# EasyEDA Pro project 嵌入式.eprj, schematic Schematic1
Create Date: 2024-04-08; Page Name: 6612; Project Name: 嵌入式; Schematic Name: Schematic1; Update Date: 2024-04-08; Company: 嘉立创EDA; Page Size: A4; Version: V1.0
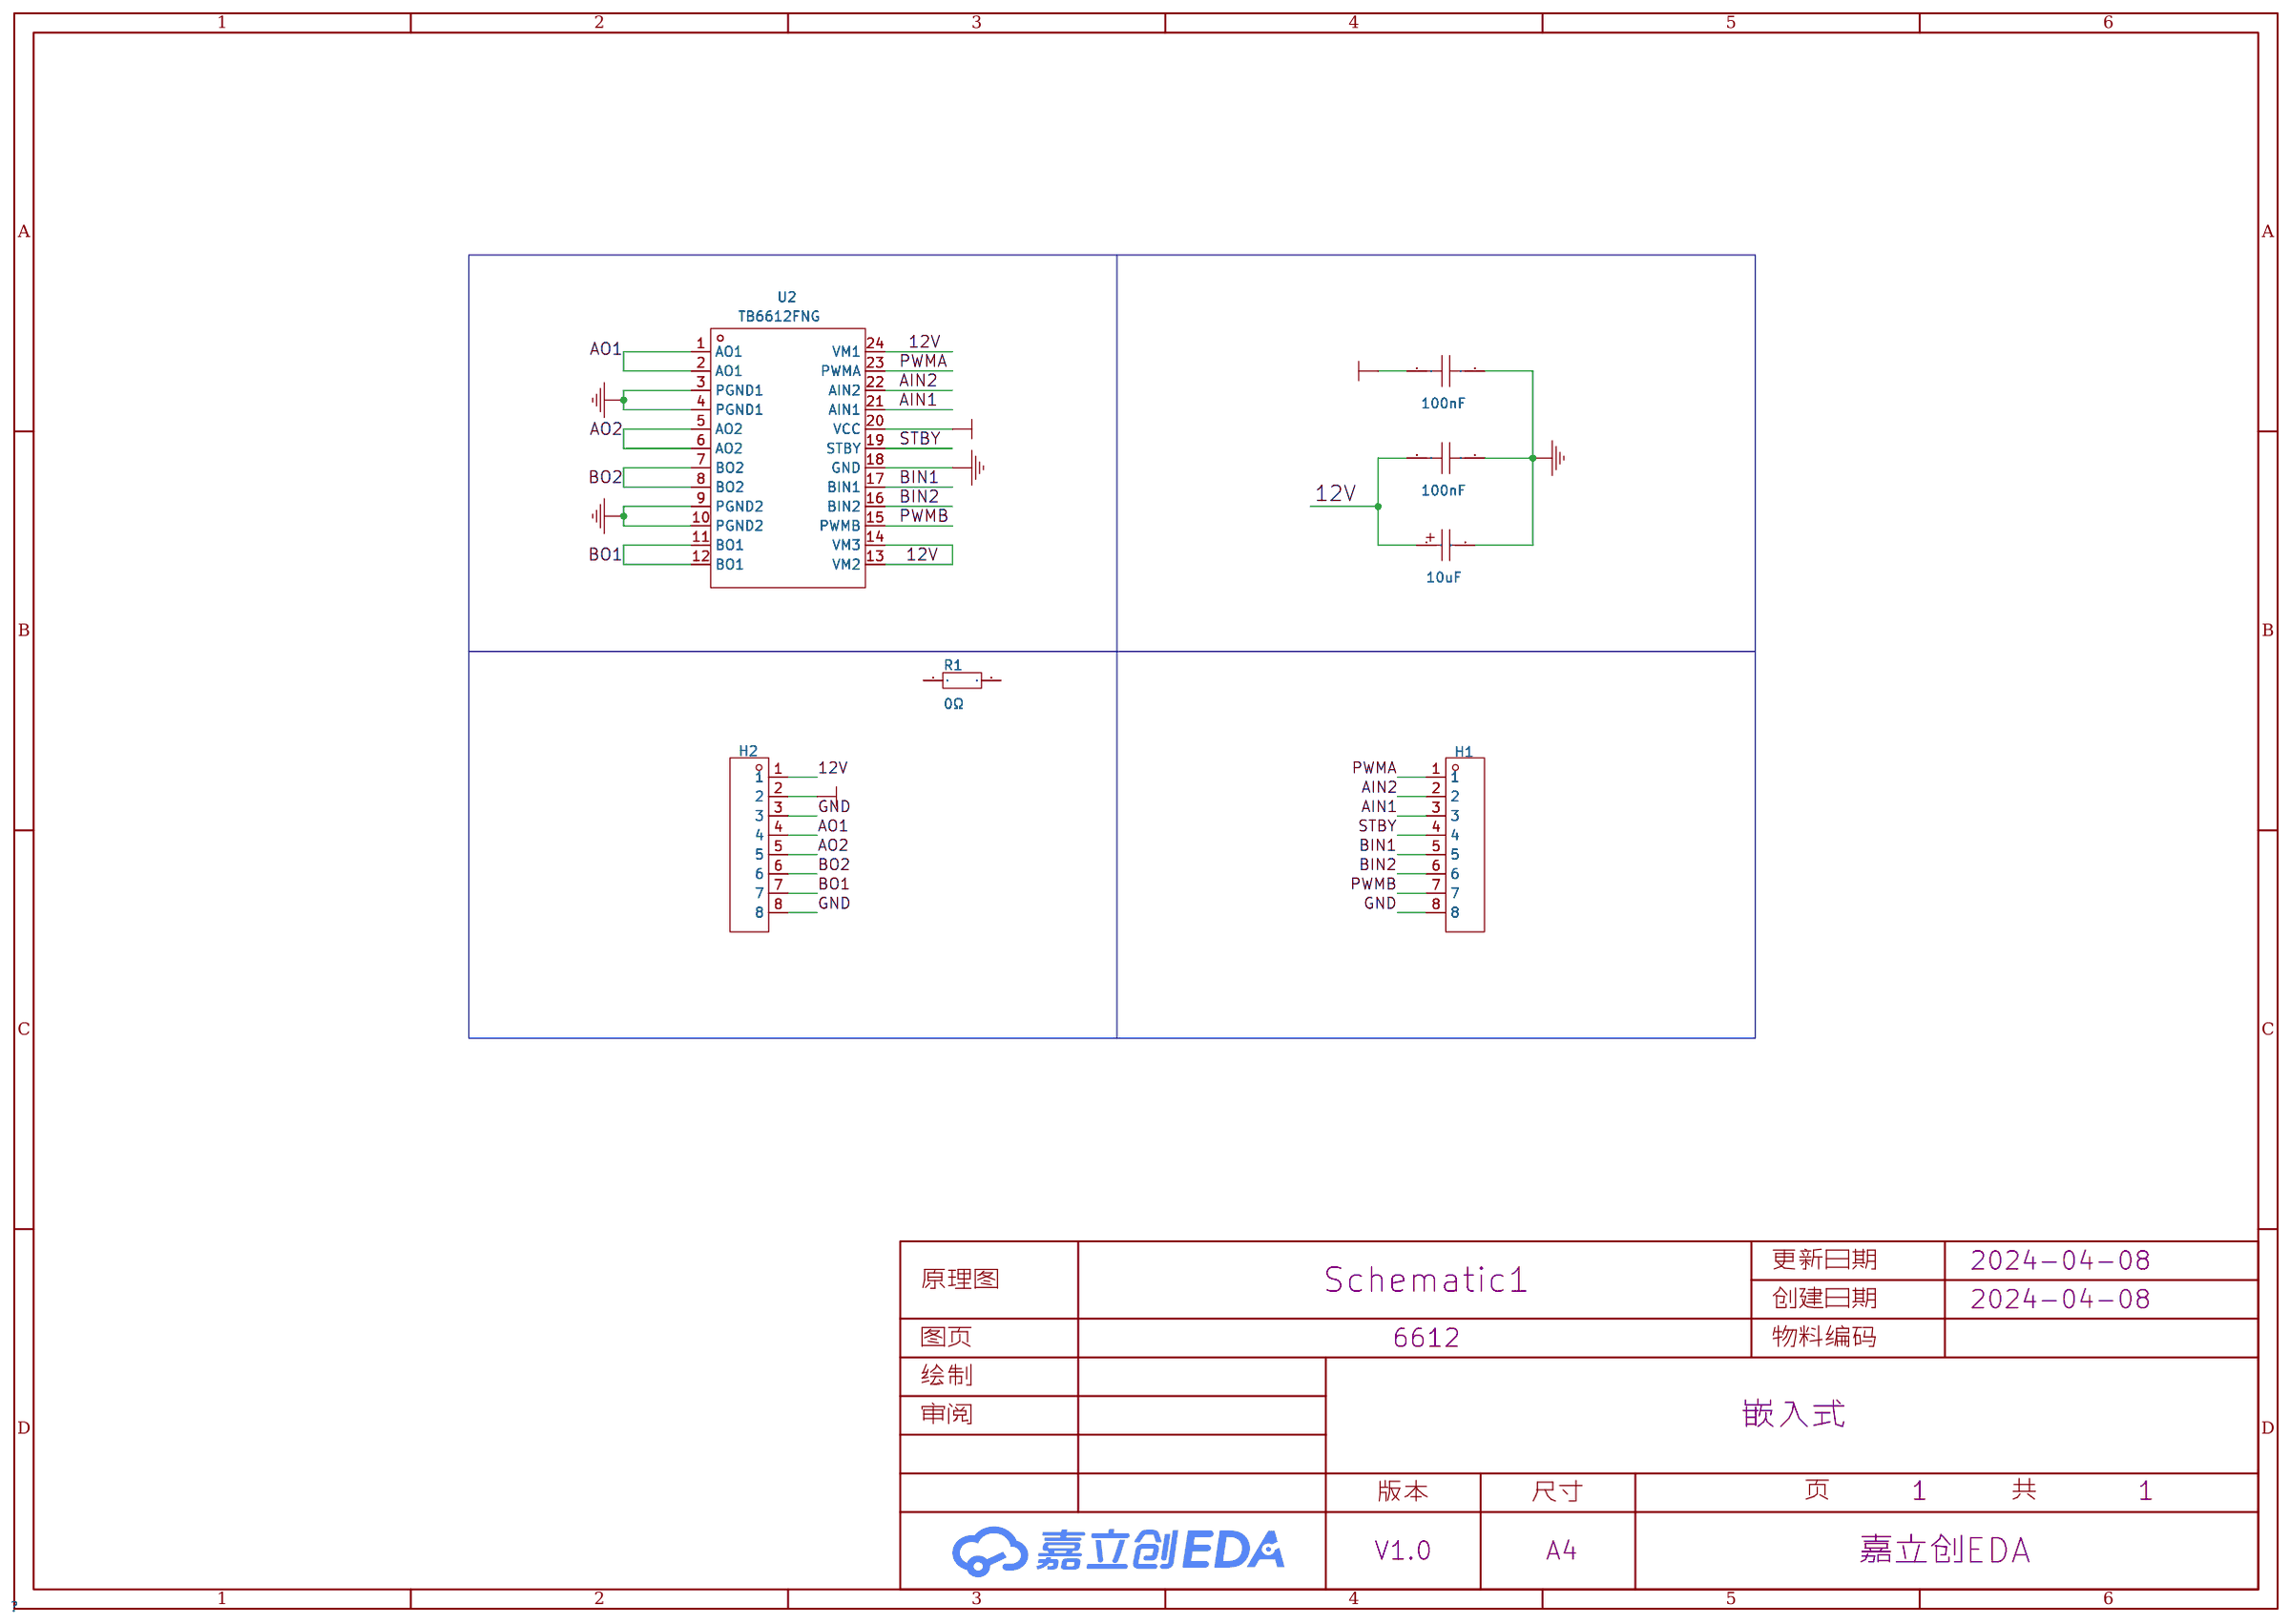
[diagram p2: schematic sheet]

## Parts
C3  100nF  [C0603]
C4  100nF  [C0603]
C5  10uF  [CAP-SMD_L3.5-W2.8-R-RD]
H1  KH-2.54PH180-1X8P-L11.5  [HDR-TH_8P-P2.54-V-M]
H2  KH-2.54PH180-1X8P-L11.5  [HDR-TH_8P-P2.54-V-M]
R1  0Ω  [R1206]
U2  TB6612FNG  [SSOP-24_L8.3-W5.6-P0.65-LS7.6-BL]

## Library data of the parts
C3 C4 = 100nF: link: https://item.szlcsc.com/362304.html; 3DModel: C0603_L1.6-W0.8-H0.8; Supplier: LCSC; Manufacturer: SAMSUNG(三星); Manufacturer Part: CL10B104KB8NNNC; Supplier Part: C1591; JLCPCB Part Class: Extended Part
C5 = 10uF: link: https://atta.szlcsc.com/upload/public/pdf/source/20160107/1457707745471.pdf; 3DModel: CASE-B_L3.5-W2.8-H1.9; Supplier: LCSC; Manufacturer: Kyocera AVX; Manufacturer Part: TAJB106K025RNJ; Supplier Part: C7194; JLCPCB Part Class: Extended Part
H1 H2 = KH-2.54PH180-1X8P-L11.5: link: https://item.szlcsc.com/502963.html; Supplier: LCSC; Supplier Part: C2905487; Manufacturer: kinghelm(金航标); JLCPCB Part Class: Extended Part
R1 = 1206W4F0000T5E: 电阻类型:厚膜电阻;阻值:0Ω;精度:±1%;功率:250mW;最大工作电压:200V;温度系数:±800ppm/℃;; LCSC Part Name: 0Ω ±1% 250mW 厚膜电阻; Supplier Part: C17888; Manufacturer: UNI-ROYAL(厚声); Supplier Footprint: 1206; JLCPCB Part Class: 基础库; Datasheet: https://atta.szlcsc.com/upload/public/pdf/source/20200306/C422600_1E6D84923E4A46A82E41ADD87F860B5C.pdf; Supplier: LCSC; Type: 厚膜电阻; Tolerance: ±1%; Power(Watts): 250mW; Overload Voltage (Max): 200V; Temperature Coefficient: ±800ppm/℃; Operating Temperature Range: -55℃~+155℃
U2 = TB6612FNG: link: https://item.szlcsc.com/152848.html; Supplier: LCSC; Manufacturer: TOSHIBA(东芝); Manufacturer Part: TB6612FNG,C,8,EL; Supplier Part: C141517; JLCPCB Part Class: Extended Part

## Nets
12V: C4.2 C5.1 H2.1 U2.13(VM2) U2.14(VM3) U2.24(VM1)
GND: C3.2 C4.1 C5.2 H1.8 H2.3 H2.8 U2.3(PGND1) U2.4(PGND1) U2.9(PGND2) U2.10(PGND2) U2.18(GND)
VCC: C3.1 H2.2 U2.20(VCC)
AIN1: H1.3 U2.21(AIN1)
AIN2: H1.2 U2.22(AIN2)
AO1: H2.4 U2.1(AO1) U2.2(AO1)
AO2: H2.5 U2.5(AO2) U2.6(AO2)
BIN1: H1.5 U2.17(BIN1)
BIN2: H1.6 U2.16(BIN2)
BO1: H2.7 U2.11(BO1) U2.12(BO1)
BO2: H2.6 U2.7(BO2) U2.8(BO2)
PWMA: H1.1 U2.23(PWMA)
PWMB: H1.7 U2.15(PWMB)
STBY: H1.4 U2.19(STBY)

Not connected (* = marked no-connect by the designer): R1 1 2
